# Altium schematic sheet Demonstarion.SchDoc
size 420 x 297 mm
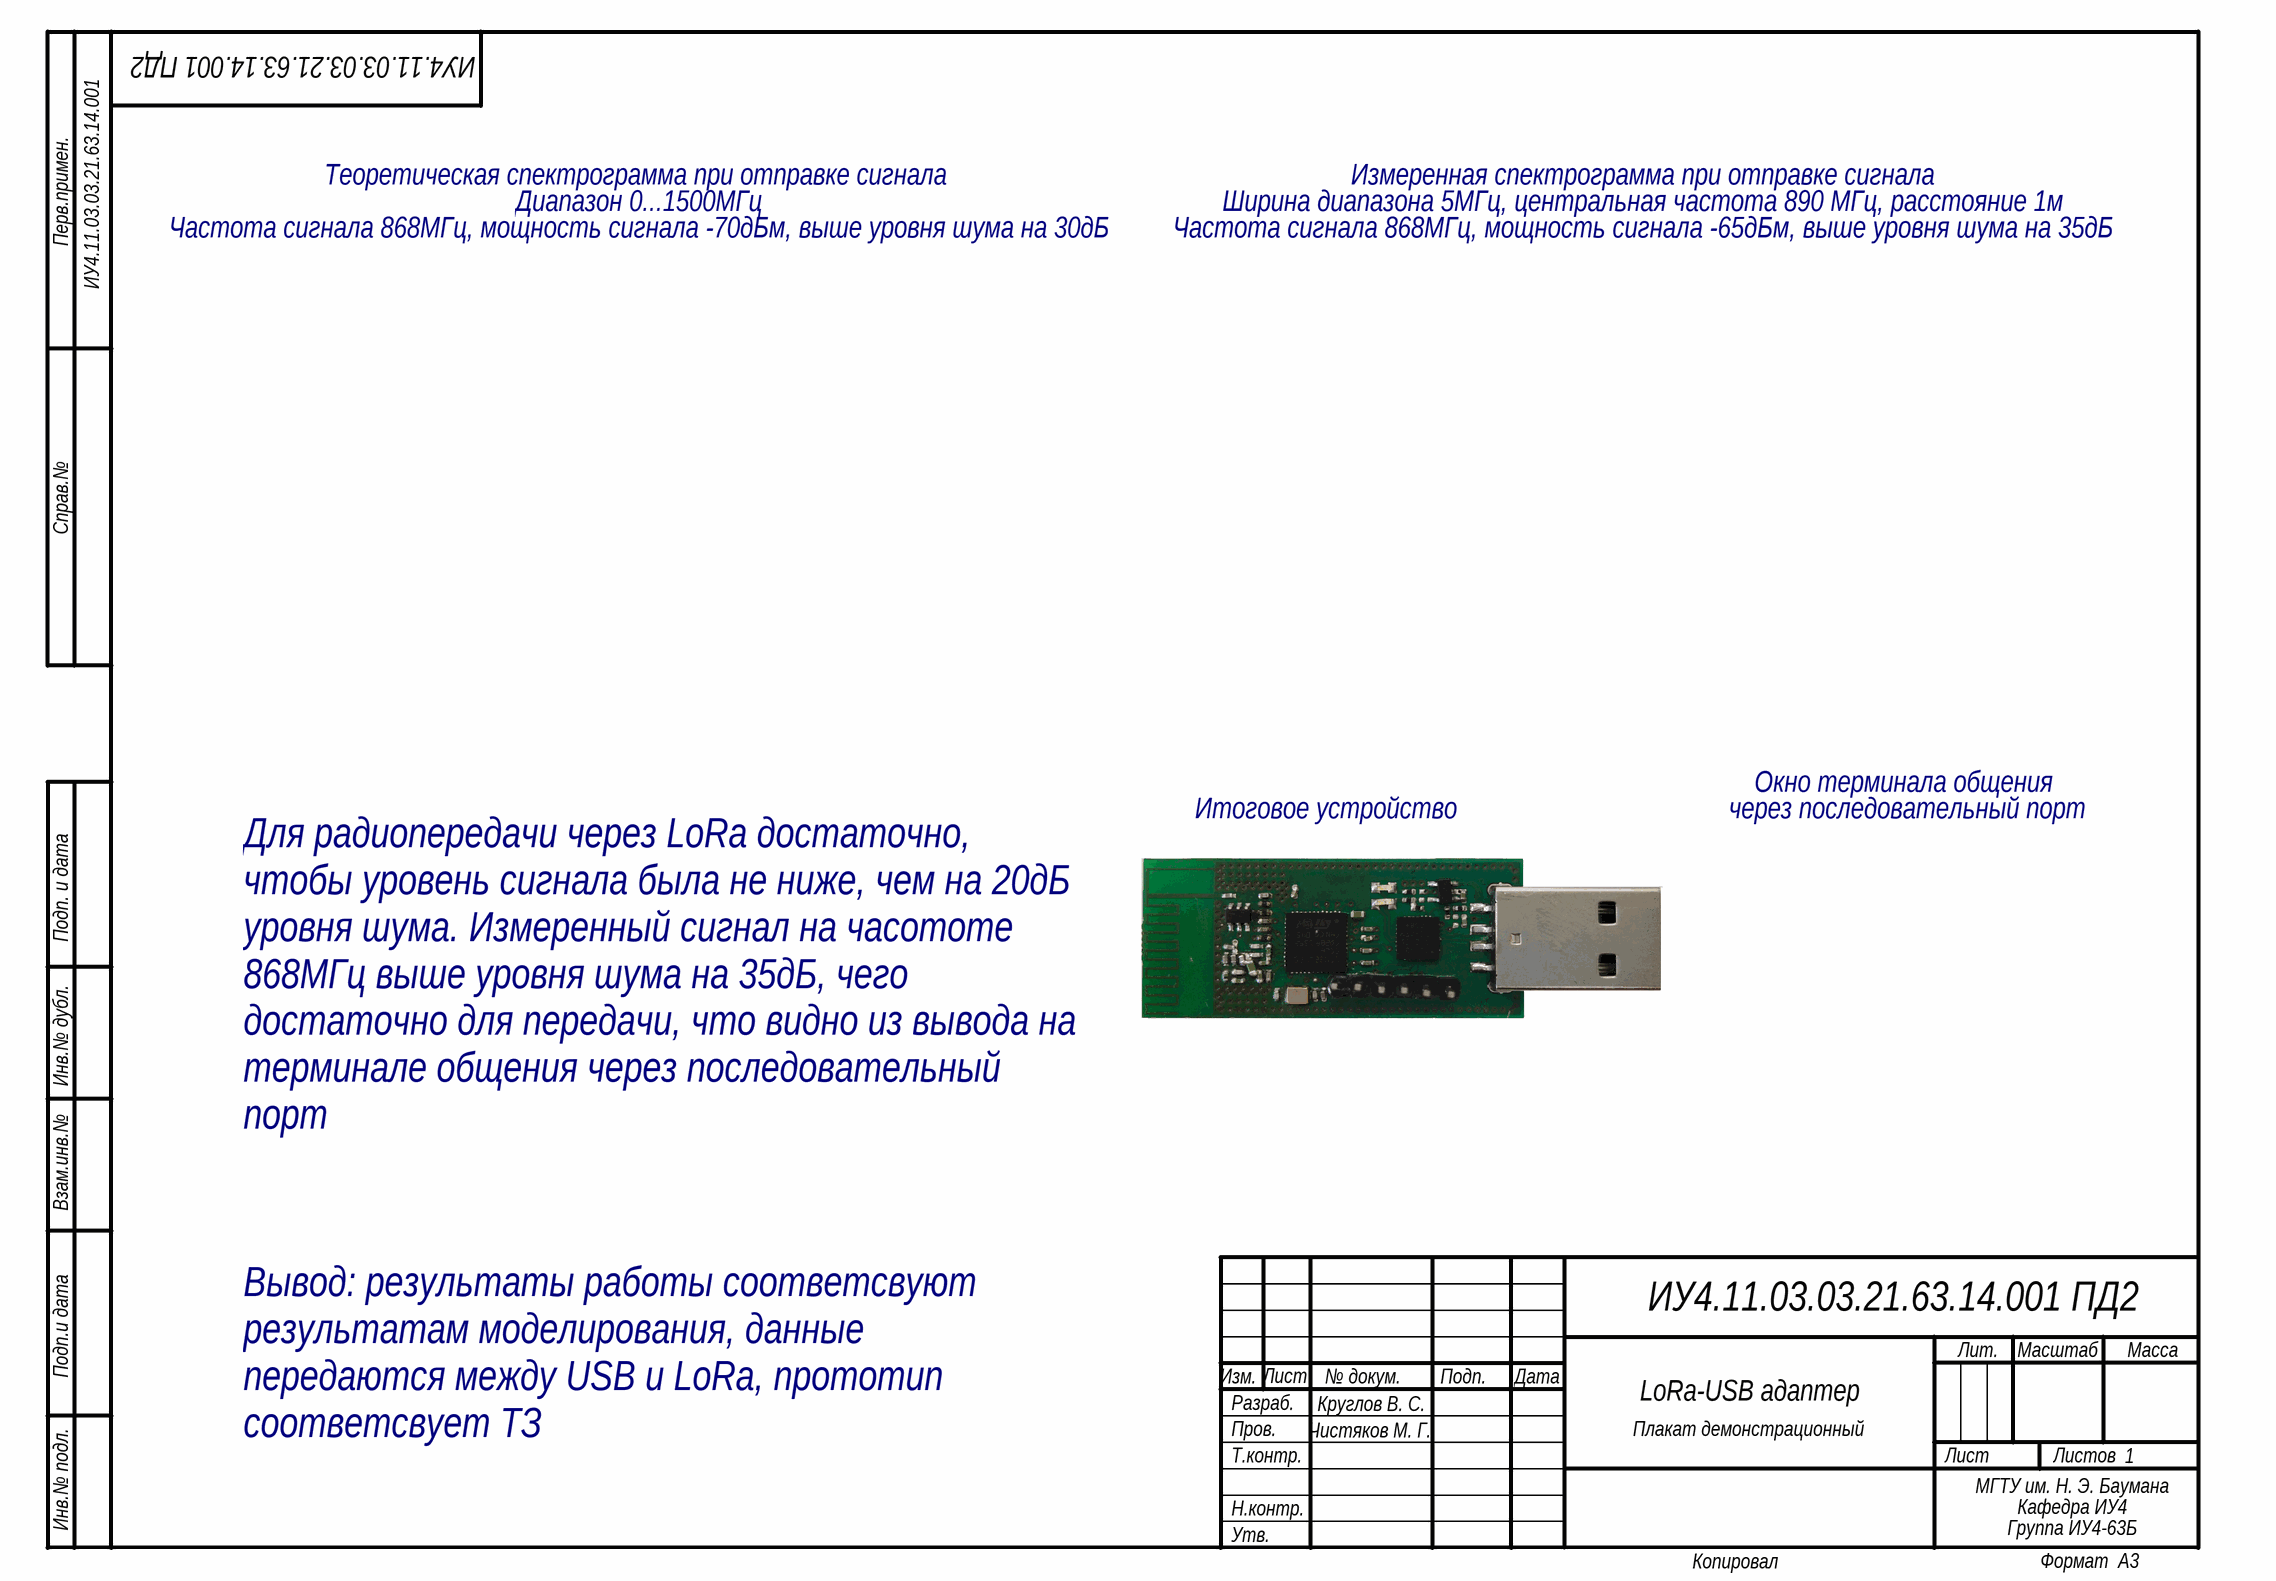
[diagram p0: Demonstarion.SchDoc]

## Notes on the sheet
- ИУ4.11.03.03.21.63.14.001 ПД2
- ИУ4.11.03.03.21.63.14.001
- Теоретическая спектрограмма при отправке сигнала
- Измеренная спектрограмма при отправке сигнала
- Частота сигнала 868МГц, мощность сигнала -70дБм, выше уровня шума на 30дБ
- Диапазон 0...1500МГц
- Частота сигнала 868МГц, мощность сигнала -65дБм, выше уровня шума на 35дБ
- Ширина диапазона 5МГц, центральная частота 890 МГц, расстояние 1м
- Окно терминала общения
- Итоговое устройство
- через последовательный порт
- Для радиопередачи через LoRa достаточно, чтобы уровень сигнала была не ниже, чем на 20дБ уровня шума. Измеренный сигнал на часототе 868МГц выше уровня шума на 35дБ, чего достаточно для передачи, что видно из вывода на терминале общения через последовательный порт
- Круглов В. С.
- LoRa-USB адаптер
- Чистяков М. Г.
- Плакат демонстрационный
- 1
- МГТУ им. Н. Э. Баумана
- Кафедра ИУ4
- Группа ИУ4-63Б
- Вывод: результаты работы соответсвуют результатам моделирования, данные передаются между USB и LoRa, прототип соответсвует ТЗ
- Копировал
- Перв.примен.
- Справ.№
- Подп. и дата
- Инв.№ дубл.
- Взам.инв.№
- Подп.и дата
- Разраб.
- Изм.
- Лист
- № докум.
- Подп.
- Дата
- Лит.
- Масштаб
- Масса
- Т.контр.
- Пров.
- Листов
- Инв.№ подл.
- Утв.
- Н.контр.
- Формат  A3